# EasyEDA Pro project 3SE_24_Power_Rune.eprj, schematic Armour (continued)
## Sheets (continued)
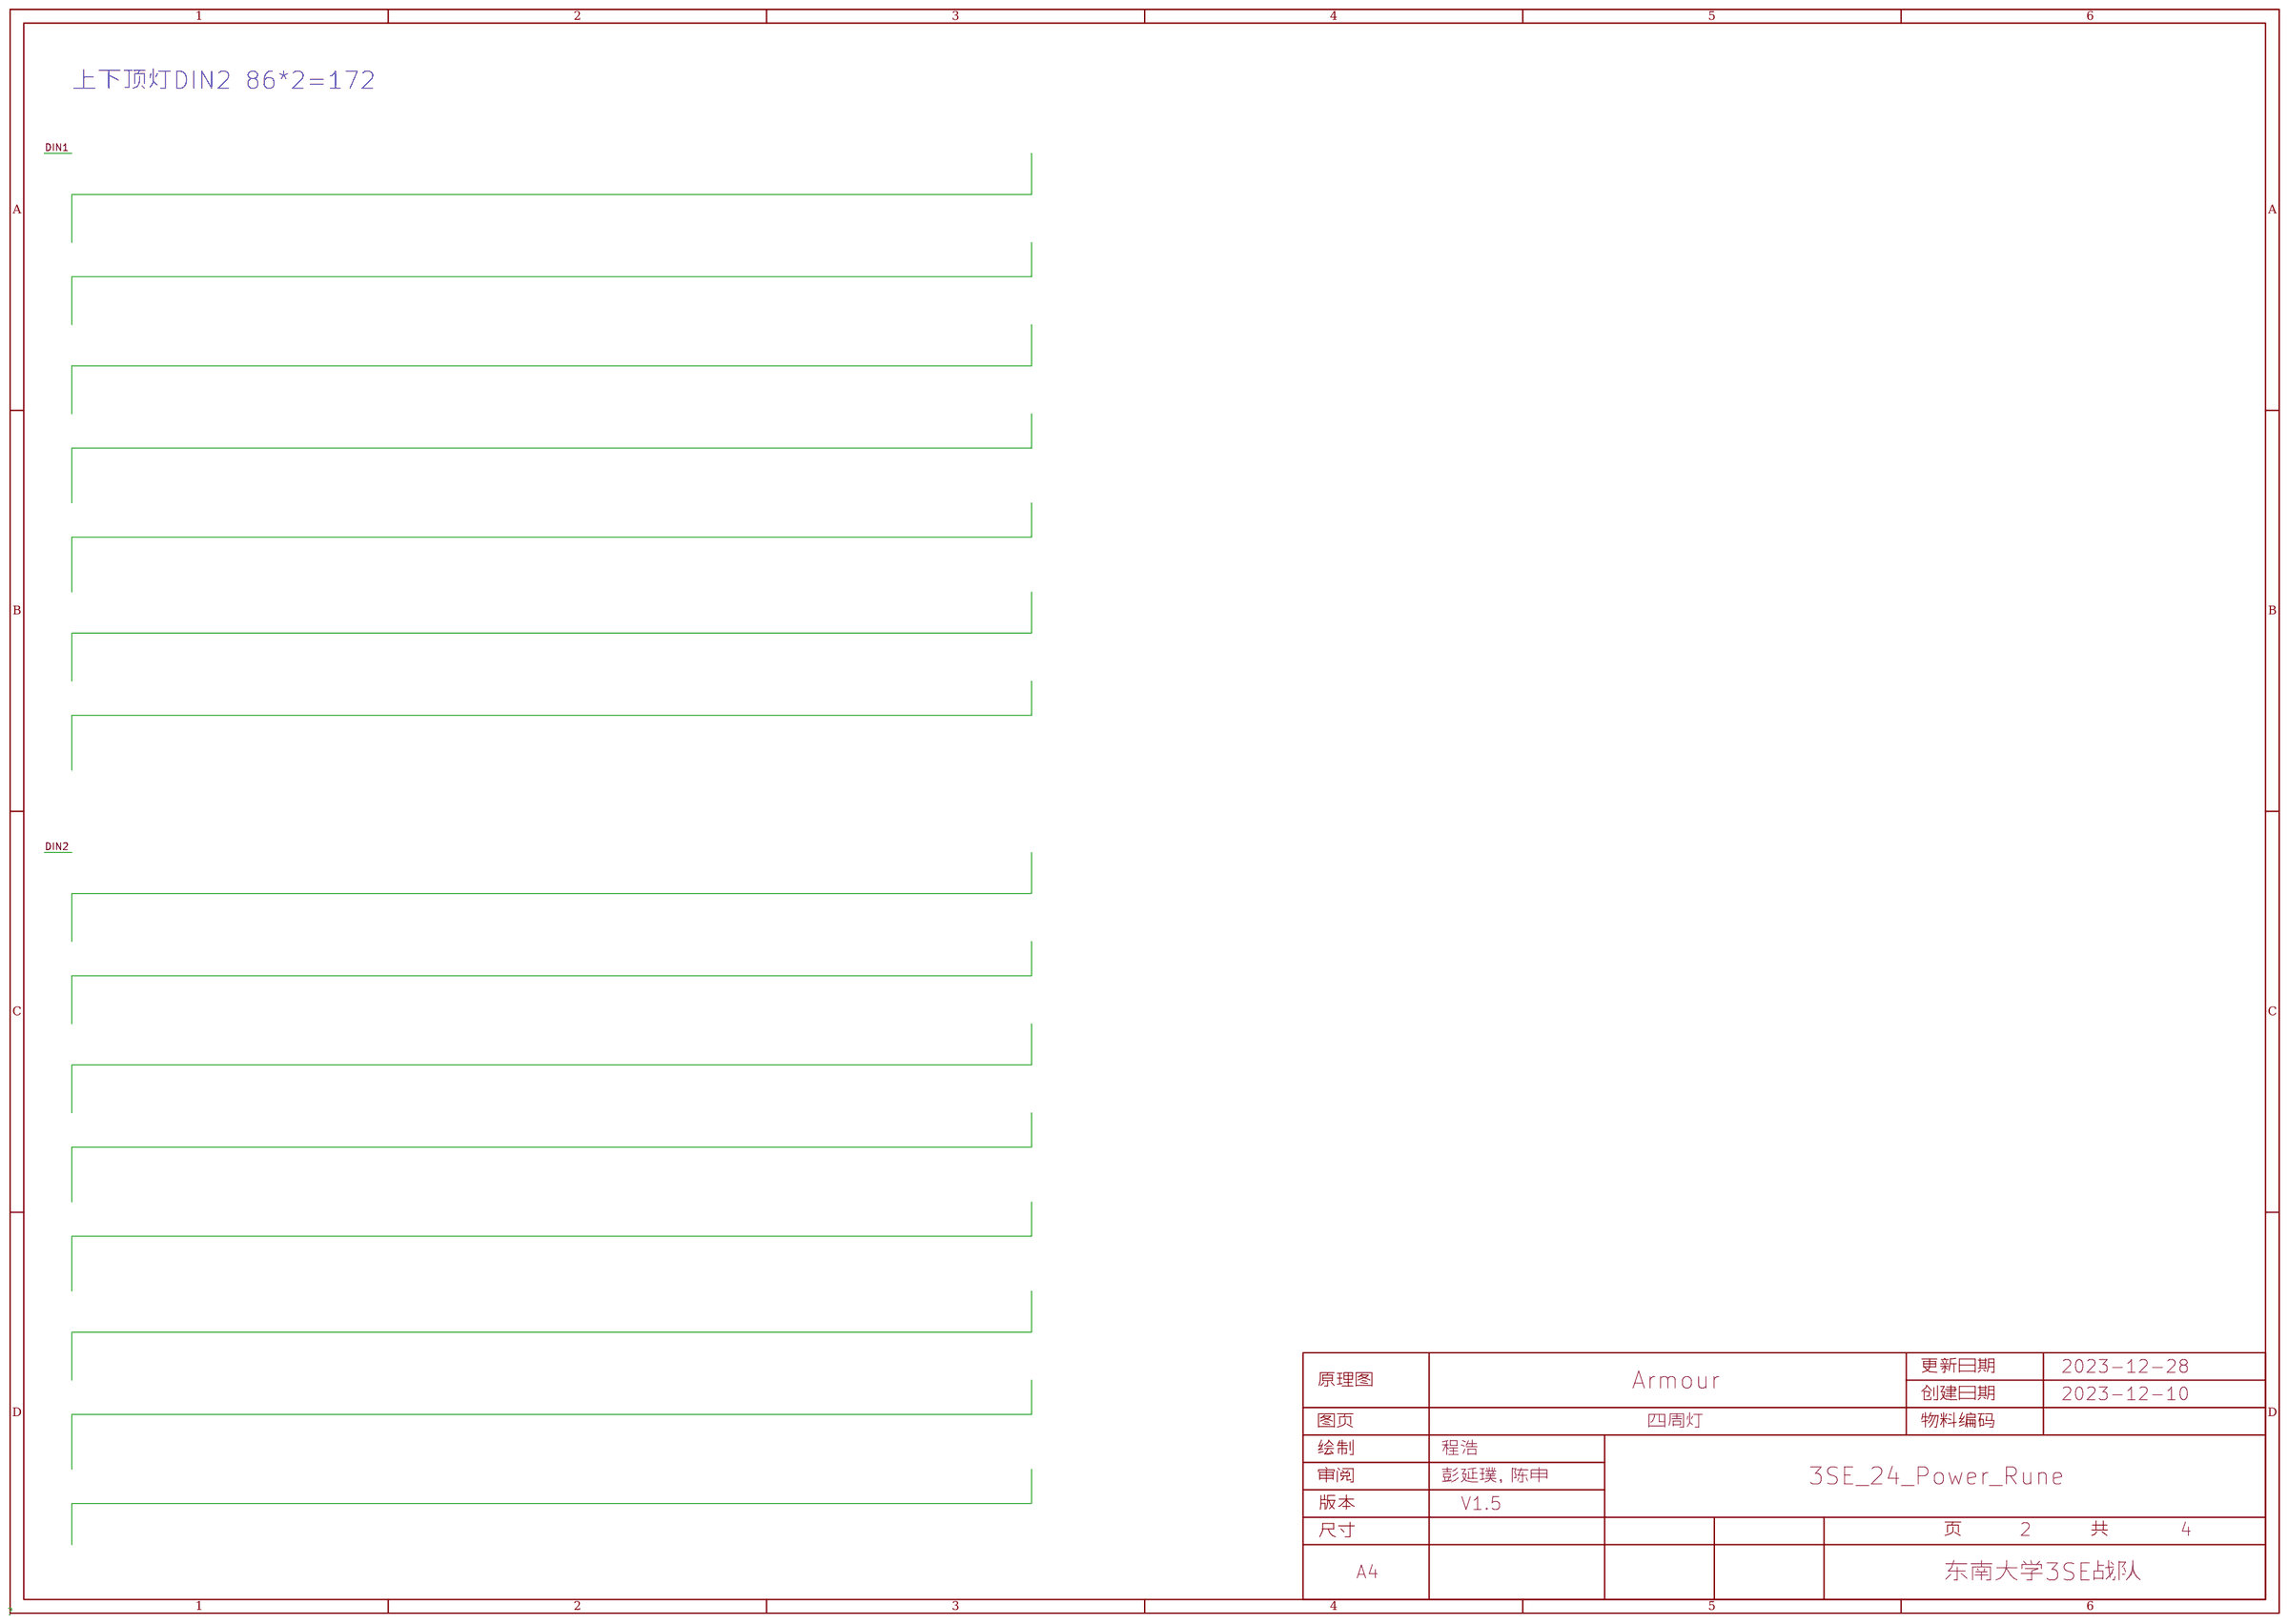
[diagram p5: 四周灯]

## Parts
sheet 主控和电源
3V3  -  [Test-Point-0.5mm]
5V  -  [Test-Point-0.5mm]
24V  -  [Test-Point-0.5mm]
C431  1uF  [C0603]
C432  470uF  [CAP-SMD_BD10.0-L10.3-W10.3-LS11.0-FD]
C433  1uF  [C0603]
C434  10uF  [C0603]
C435  100nF  [C0603]
C436  1000uF  [CAP-SMD_BD12.5-L13.0-W13.0-RD]
C437  1uF  [C0603]
C438  33nF  [C0603]
C439  100nF  [C0603]
C440  10uF  [C0603]
C441  100nF  [C0603]
C442  100nF  [C0603]
C443  100nF  [C0603]
C444  100nF  [C0603]
C445  1uF  [C0603]
C446  100nF  [C0603]
C447  100nF  [C0603]
C448  100nF  [C0603]
C449  100nF  [C0603]
C450  1uF  [C0603]
C451  100nF  [C0603]
C452  12pF  [C0603]
C453  100nF  [C0603]
C454  12pF  [C0603]
C456  100nF  [C0603]
C457  100nF  [C0603]
CN1  XT30PW-M  [CONN-TH_XT30PW-M]
CN2  SM03B-GHS-TB(LF)(SN)  [CONN-TH_SM03B-GHS-TB-LF-SN]
CN3  SM03B-GHS-TB(LF)(SN)  [CONN-TH_SM03B-GHS-TB-LF-SN]
CN4  HC-GH-2PWT  [CONN-SMD_2P-P1.25_HCTL_HC-GH-2PWTKK]
CN5  XT30PW-F  [CONN-TH_XT30PW-F-1]
CN6  WAFER-GH1.25-4PWB  [CONN-SMD_4P-P1.25_XUNPU_WAFER-GH1.25-4PWB]
D1  ESDBM24VD3  [SOD-323_L1.7-W1.3-LS2.6-BI]
D2  SB1045L  [TO-277_3P-L5.4-W4.0-LS6.5-TR]
D3  SMBJ6.0CA  [SMB_L4.6-W3.6-LS5.3-BI]
D4  USBLC6-2SC6  [SOT-23-6_L2.9-W1.6-P0.95-LS2.8-BL]
L1  47uH  [IND-SMD_L17.5-W17.2]
LED431  NCD0603R1  [LED0603-RD_RED]
R1  10kΩ  [R0603]
R2  10kΩ  [R0603]
R3  10kΩ  [R0603]
R4  1kΩ  [R0603]
R5  10kΩ  [R0603]
R6  3.3kΩ  [R0603]
R7  1kΩ  [R0603]
R8  10kΩ  [R0603]
R9  1kΩ  [R0603]
R10  1kΩ  [R0603]
R11  10kΩ  [R0603]
R12  10kΩ  [R0603]
R13  1kΩ  [R0603]
R14  10kΩ  [R0603]
R15  10kΩ  [R0603]
R16  1kΩ  [R0603]
R17  10kΩ  [R0603]
R18  10kΩ  [R0603]
R19  1kΩ  [R0603]
R20  10kΩ  [R0603]
R21  1kΩ  [R0603]
R22  10kΩ  [R0603]
R23  10kΩ  [R0603]
R24  10kΩ  [R0603]
R25  10kΩ  [R0603]
R26  10kΩ  [R0603]
R27  1kΩ  [R0603]
R28  10kΩ  [R0603]
R29  1kΩ  [R0603]
R30  1kΩ  [R0603]
R31  10kΩ  [R0603]
R32  5.1kΩ  [R0603]
R33  5.1kΩ  [R0603]
SW1  TS-1101-C-W  [SW-SMD_L6.0-W3.3-LS8.0]
SW2  TS-1101-C-W  [SW-SMD_L6.0-W3.3-LS8.0]
SW3  DSHP01TSGER  [SW-SMD_DSHP01TSGER]
U1  XL4016E1  [TO-220-5_L15.5-W10.5-P1.70-BL_ON_CASE-314A-03]
U2  AMS1117-3.3  [SOT-223-4_L6.5-W3.5-P2.30-LS7.0-BR]
U3  ESP32-S3-WROOM-1-N8R2  [WIRELM-SMD_ESP32-S3-WROOM-1]
U4  74HC4051D,653  [SOIC-16_L9.9-W3.9-P1.27-LS6.0-BL]
USB1  TYPE-C 16PIN 2MD(073)  [USB-C-SMD_TYPE-C-6PIN-2MD-073]
X1  32.768kHz  [FC-135R_L3.2-W1.5]
sheet 十环灯
CBB1  -
CBB2  -
CBB3  -
CBB4  -
CBB5  -
CBB6  -
CBB7  -
CBB8  -
CBB9  -
CBB10  -
CBB11  -
CBB12  -
CBB13  -
CBB14  -
CBB15  -
CBB16  -
CBB17  -
CBB18  -
CBB19  -
CBB20  -
CBB21  -
CBB22  -
CBB23  -
CBB24  -
CBB25  -
CBB26  -
CBB27  -
CBB28  -
CBB29  -
CBB30  -
CBB31  -
CBB32  -
CBB33  -
CBB34  -
CBB35  -
CBB36  -
CBB37  -
CBB38  -
CBB39  -
CBB40  -
CBB41  -
CBB42  -
CBB43  -
CBB44  -
CBB45  -
CBB46  -
CBB47  -
CBB48  -
CBB49  -
CBB50  -
CBB51  -
CBB52  -
CBB53  -
CBB54  -
CBB55  -
CBB56  -
CBB57  -
CBB58  -
CBB59  -
CBB60  -
CBB61  -
CBB62  -
CBB63  -
CBB64  -
CBB65  -
CBB66  -
CBB67  -
CBB68  -
CBB69  -
CBB70  -
CBB71  -
CBB72  -
CBB73  -
CBB74  -
CBB75  -
CBB76  -
CBB77  -
CBB78  -
CBB79  -
CBB80  -
CBB81  -
CBB82  -
CBB83  -
CBB84  -
CBB85  -
CBB86  -
CBB87  -
CBB88  -
CBB89  -
CBB90  -
CBB91  -
CBB92  -
CBB93  -
CBB94  -
CBB95  -
CBB96  -
CBB97  -
CBB98  -
CBB99  -
CBB100  -
CBB101  -
CBB102  -
CBB103  -
CBB104  -
CBB105  -
CBB106  -
CBB107  -
CBB108  -
CBB109  -
CBB110  -
CBB111  -
CBB112  -
CBB113  -
CBB114  -
CBB115  -
CBB116  -
CBB117  -
CBB118  -
CBB119  -
CBB120  -
CBB121  -
CBB122  -
CBB123  -
CBB124  -
CBB125  -
CBB126  -
CBB127  -
CBB128  -
CBB129  -
CBB130  -
CBB131  -
CBB132  -
CBB133  -
CBB134  -
CBB135  -
CBB136  -
CBB137  -
CBB138  -
CBB139  -
CBB140  -
CBB141  -
CBB142  -
CBB143  -
CBB144  -
CBB145  -
CBB146  -
CBB147  -
CBB148  -
CBB149  -
CBB150  -
CBB151  -
CBB152  -
CBB153  -
CBB154  -
CBB155  -
CBB156  -
CBB157  -
CBB158  -
CBB159  -
CBB160  -
CBB161  -
CBB162  -
CBB163  -
CBB164  -
CBB165  -
CBB166  -
CBB167  -
CBB168  -
CBB169  -
CBB170  -
CBB171  -
CBB172  -
CBB173  -
CBB174  -
CBB175  -
CBB176  -
CBB177  -
CBB178  -
CBB179  -
CBB180  -
CBB181  -
CBB182  -
CBB183  -
CBB184  -
CBB185  -
CBB186  -
CBB187  -
CBB188  -
CBB189  -
CBB190  -
CBB191  -
CBB192  -
CBB193  -
CBB194  -
CBB195  -
CBB196  -
CBB197  -
CBB198  -
CBB199  -
CBB200  -
CBB201  -
CBB202  -
CBB203  -
CBB204  -
CBB205  -
CBB206  -
CBB207  -
CBB208  -
CBB209  -
CBB210  -
CBB211  -
CBB212  -
CBB213  -
CBB214  -
CBB215  -
CBB216  -
CBB217  -
CBB218  -
CBB219  -
CBB220  -
CBB221  -
CBB222  -
CBB223  -
CBB224  -
CBB225  -
CBB226  -
CBB227  -
CBB228  -
CBB229  -
CBB230  -
CBB231  -
CBB232  -
CBB233  -
CBB234  -
CBB235  -
CBB236  -
CBB237  -
CBB238  -
CBB239  -
CBB240  -
CBB241  -
CBB242  -
CBB243  -
CBB244  -
CBB245  -
CBB246  -
CBB247  -
CBB248  -
CBB249  -
CBB250  -
CBB251  -
CBB252  -
CBB253  -
CBB254  -
CBB255  -
CBB256  -
CBB257  -
CBB258  -
sheet 四周灯
CBB259  -
CBB260  -
CBB261  -
CBB262  -
CBB263  -
CBB264  -
CBB265  -
CBB266  -
CBB267  -
CBB268  -
CBB269  -
CBB270  -
CBB271  -
CBB272  -
CBB273  -
CBB274  -
CBB275  -
CBB276  -
CBB277  -
CBB278  -
CBB279  -
CBB280  -
CBB281  -
CBB282  -
CBB283  -
CBB284  -
CBB285  -
CBB286  -
CBB287  -
CBB288  -
CBB289  -
CBB290  -
CBB291  -
CBB292  -
CBB293  -
CBB294  -
CBB295  -
CBB296  -
CBB297  -
CBB298  -
CBB299  -
CBB300  -
CBB301  -
CBB302  -
CBB303  -
CBB304  -
CBB305  -
CBB306  -
CBB307  -
CBB308  -
CBB309  -
CBB310  -
CBB311  -
CBB312  -
CBB313  -
CBB314  -
CBB315  -
CBB316  -
CBB317  -
CBB318  -
CBB319  -
CBB320  -
CBB321  -
CBB322  -
CBB323  -
CBB324  -
CBB325  -
CBB326  -
CBB327  -
CBB328  -
CBB329  -
CBB330  -
CBB331  -
CBB332  -
CBB333  -
CBB334  -
CBB335  -
CBB336  -
CBB337  -
CBB338  -
CBB339  -
CBB340  -
CBB341  -
CBB342  -
CBB343  -
CBB344  -
CBB345  -
CBB346  -
CBB347  -
CBB348  -
CBB349  -
CBB350  -
CBB351  -
CBB352  -
CBB353  -
CBB354  -
CBB355  -
CBB356  -
CBB357  -
CBB358  -
CBB359  -
CBB360  -
CBB361  -
CBB362  -
CBB363  -
CBB364  -
CBB365  -
CBB366  -
CBB367  -
CBB368  -
CBB369  -
CBB370  -
CBB371  -
CBB372  -
CBB373  -
CBB374  -
CBB375  -
CBB376  -
CBB377  -
CBB378  -
CBB379  -
CBB380  -
CBB381  -
CBB382  -
CBB383  -
CBB384  -
CBB385  -
CBB386  -
CBB387  -
CBB388  -
CBB389  -
CBB390  -
CBB391  -
CBB392  -
CBB393  -
CBB394  -
CBB395  -
CBB396  -
CBB397  -
CBB398  -
CBB399  -
CBB400  -
CBB401  -
CBB402  -
CBB403  -
CBB404  -
CBB405  -
CBB406  -
CBB407  -
CBB408  -
CBB409  -
CBB410  -
CBB411  -
CBB412  -
CBB413  -
CBB414  -
CBB415  -
CBB416  -
CBB417  -
CBB418  -
CBB419  -
CBB420  -
CBB421  -
CBB422  -
CBB423  -
CBB424  -
CBB425  -
CBB426  -
CBB427  -
CBB428  -
CBB429  -
CBB430  -
CBB431  -
CBB432  -
CBB433  -
CBB434  -
CBB435  -
CBB436  -
sheet 按键
KEY1  -  [热插拔轴座]
KEY2  -  [热插拔轴座]
KEY3  -  [热插拔轴座]
KEY4  -  [热插拔轴座]
KEY5  -  [热插拔轴座]
KEY6  -  [热插拔轴座]
KEY7  -  [热插拔轴座]
KEY8  -  [热插拔轴座]
KEY9  -  [热插拔轴座]
KEY10  -  [热插拔轴座]
KEY11  -  [热插拔轴座]
KEY12  -  [热插拔轴座]
KEY13  -  [热插拔轴座]
KEY14  -  [热插拔轴座]
KEY15  -  [热插拔轴座]
KEY16  -  [热插拔轴座]
KEY17  -  [热插拔轴座]
KEY18  -  [热插拔轴座]
KEY19  -  [热插拔轴座]
KEY20  -  [热插拔轴座]
KEY21  -  [热插拔轴座]
KEY22  -  [热插拔轴座]
KEY23  -  [热插拔轴座]
KEY24  -  [热插拔轴座]
KEY25  -  [热插拔轴座]
KEY26  -  [热插拔轴座]
KEY27  -  [热插拔轴座]
KEY28  -  [热插拔轴座]
KEY29  -  [热插拔轴座]
KEY30  -  [热插拔轴座]
KEY31  -  [热插拔轴座]
KEY32  -  [热插拔轴座]
KEY33  -  [热插拔轴座]
KEY34  -  [热插拔轴座]
KEY35  -  [热插拔轴座]
KEY36  -  [热插拔轴座]
KEY37  -  [热插拔轴座]
KEY38  -  [热插拔轴座]
KEY39  -  [热插拔轴座]
KEY40  -  [热插拔轴座]
KEY41  -  [热插拔轴座]
KEY42  -  [热插拔轴座]
KEY43  -  [热插拔轴座]
KEY44  -  [热插拔轴座]
KEY45  -  [热插拔轴座]
KEY46  -  [热插拔轴座]
KEY47  -  [热插拔轴座]
KEY48  -  [热插拔轴座]
KEY49  -  [热插拔轴座]
KEY50  -  [热插拔轴座]
KEY51  -  [热插拔轴座]

## Library data of the parts
3V3 5V 24V = Test-Point: Test Point 测试点; Check: false
C431 C433 C437 C445 C450 = CL10A105KB8NNNC: 容值:1uF;精度:±10%;额定电压:50V;材质(温度系数):X5R;; LCSC Part Name: 1uF ±10% 50V; Supplier Part: C15849; Manufacturer: SAMSUNG(三星); Supplier Footprint: 0603; JLCPCB Part Class: Basic Part; Datasheet: https://atta.szlcsc.com/upload/public/pdf/source/20160218/1457707763339.pdf; Supplier: LCSC; Tolerance: ±10%; Voltage Rated: 50V; Temperature Coefficient: X5R
C432 = RVT470UF35V67RV0056: 容值:470uF;精度:±20%;额定电压:35V;纹波电流:286mA@120Hz;等效串联电阻:-;; LCSC Part Name: 470uF ±20% 35V; Supplier Part: C2836436; Manufacturer: KNSCHA(科尼盛); Supplier Footprint: SMD,D10xL10.2mm; JLCPCB Part Class: 扩展库; Datasheet: https://atta.szlcsc.com/upload/public/pdf/source/20210528/C2836436_C8D3EEA5E3C1CA7F9FA48FC22CF12531.pdf; Supplier: LCSC; Tolerance: ±20%; Rated Voltage: 35V; Ripple Current: 286mA@120Hz; φD: 10mm; L: 10.2mm; Lifetime @ Temp: 2000hrs@105℃; Operating Temperature: -55℃~+105℃
C434 C440 = CL10A106KP8NNNC: 容值:10uF;精度:±10%;额定电压:10V;材质(温度系数):X5R;; LCSC Part Name: 10uF ±10% 10V; Supplier Part: C19702; Manufacturer: SAMSUNG(三星); Supplier Footprint: 0603; JLCPCB Part Class: Basic Part; Datasheet: https://atta.szlcsc.com/upload/public/pdf/source/20160218/1457707763339.pdf; Supplier: LCSC; Tolerance: ±10%; Voltage Rated: 10V; Temperature Coefficient: X5R
C435 C439 C441-C444 C446-C449 C451 C453 C456 C457 = CC0603KRX7R9BB104: 容值:100nF;精度:±10%;额定电压:50V;材质(温度系数):X7R;; LCSC Part Name: 100nF ±10% 50V; Supplier Part: C14663; Manufacturer: YAGEO(国巨); Supplier Footprint: 0603; JLCPCB Part Class: Basic Part; Datasheet: https://atta.szlcsc.com/upload/public/pdf/source/20180910/C282072_33301C7F631E79921B82A8DAC6BCC5B3.pdf; Supplier: LCSC; Tolerance: ±10%; Voltage Rated: 50V; Temperature Coefficient: X7R
C436 = RVT1E102M1213: 容值:1000uF;精度:±20%;额定电压:25V;纹波电流:468mA@120Hz;等效串联电阻:-;; LCSC Part Name: 1000uF ±20% 25V; Supplier Part: C90271; Manufacturer: ROQANG(容强); Supplier Footprint: SMD,D12.5xL13.5mm; JLCPCB Part Class: 扩展库; Datasheet: https://atta.szlcsc.com/upload/public/pdf/source/20170325/1490427950282.pdf; Supplier: LCSC; Tolerance: ±20%; Rated Voltage: 25V; Ripple Current: 468mA@120Hz; φD: 12.5mm; L: 13.5mm; Lifetime @ Temp: 2000hrs@105℃; Operating Temperature: -40℃~+105℃
C438 = 0603B333K500NT: 容值:33nF;精度:±10%;额定电压:50V;材质(温度系数):X7R;; LCSC Part Name: 33nF ±10% 50V; Supplier Part: C1614; Manufacturer: FH(风华); Supplier Footprint: 0603; JLCPCB Part Class: 扩展库; Datasheet: https://atta.szlcsc.com/upload/public/pdf/source/20200305/C486355_26A10D38EF8C2A5C37091D0039909270.pdf; Supplier: LCSC; Tolerance: ±10%; Voltage Rated: 50V; Temperature Coefficient: X7R
C452 C454 = CL10C120JB8NNNC: 容值:12pF;精度:±5%;额定电压:50V;材质(温度系数):C0G;; LCSC Part Name: 12pF ±5% 50V; Supplier Part: C38523; Manufacturer: SAMSUNG(三星); Supplier Footprint: 0603; JLCPCB Part Class: Basic Part; Datasheet: https://atta.szlcsc.com/upload/public/pdf/source/20160218/1457707763339.pdf; Supplier: LCSC; Tolerance: ±5%; Voltage Rated: 50V; Temperature Coefficient: C0G
CN1 = XT30PW-M: 类别:-;类型1:-;; LCSC Part Name: AMASS(艾迈斯)航模插头 卧式弯脚 XT30PW-M公头; Supplier Part: C431092; Manufacturer: AMASS(艾迈斯); JLCPCB Part Class: 扩展库; Datasheet: https://atta.szlcsc.com/upload/public/pdf/source/20220222/6A9F22F7850E25B33E1BE430ADF8560B.pdf; Supplier: LCSC; Brand: 艾迈斯; Type: 航模插头; RatedVoltage: DC 500V; InterfaceType: 公头; RatedCurrent: 15A; RecommendedWireGauge: 16/18/20AWG; contact resistance: 1.2mΩ; specifications: 2pin
CN2 CN3 = SM03B-GHS-TB(LF)(SN): 插针结构:1x3P;间距:1.25mm;安装方式:卧贴;行距:-;总PIN数:3P;排数:1;每排PIN数:3;参考系列:GH;额定电流:1A;触头材质:磷青铜;触头镀层:锡;工作温度范围:-25℃~+85℃;; LCSC Part Name: 1x3P 间距:1.25mm 卧贴 系列:GH GH系列; Supplier Part: C514175; Manufacturer: JST; Supplier Footprint: SMD,P=1.25mm; JLCPCB Part Class: Extended Part; Datasheet: https://atta.szlcsc.com/upload/public/pdf/source/20200416/C514175_6D761544780BFF1FCAB26BE8A747A99F.pdf; Supplier: LCSC; Pins Structure: 1x3P; Pitch: 1.25mm; Mounting Style: 卧贴; Number of Pins: 3P; Number of Rows: 1; Number of PINs Per Row: 3; Reference Series: GH; Current Rating (Max): 1A; Contact Material: 磷青铜; Contact Plating: 锡; Operating Temperature Range: -25℃~+85℃
CN4 = HC-GH-2PWT_C3011944: 插针结构:1x2P;间距:1.25mm;安装方式:卧贴;总PIN数:2P;排数:1;每排PIN数:2;参考系列:GH;额定电流:1A;工作温度范围:-25℃~+85℃;; LCSC Part Name: 1x2P 间距:1.25mm 卧贴 系列:GH 卧式贴片带扣 镀锡 2P; Supplier Part: C3011944; Manufacturer: HCTL(华灿天禄); Supplier Footprint: SMD,P=1.25mm; JLCPCB Part Class: 扩展库; Datasheet: https://atta.szlcsc.com/upload/public/pdf/source/20210728/C2845397_2BAB5616F3DD52263F1EF5392BF0F2D4.pdf; Supplier: LCSC; Pins Structure: 1x2P; Pitch: 1.25mm; Mounting Style: 卧贴; Number of Pins: 2P; Number of Rows: 1; Number of PINs Per Row: 2; Reference Series: GH; Current Rating (Max): 1A; Operating Temperature Range: -25℃~+85℃
CN5 = XT30PW-F: 类别:-;类型1:-;; LCSC Part Name: AMASS(艾迈斯)电源连接器 母头 XT30PW-F; Supplier Part: C2913282; Manufacturer: AMASS(艾迈斯); JLCPCB Part Class: 扩展库; Datasheet: https://atta.szlcsc.com/upload/public/pdf/source/20190916/C428722_DFF78979486FCB0B58C1FC563067EC88.pdf; Supplier: LCSC; Brand: 艾迈斯; Type: 航模插头; InterfaceType: 母头
CN6 = WAFER-GH1.25-4PWB: 参考系列:GH;间距:1.25mm;插针结构:1x4P;排数:1;每排PIN数:4;公母:公型插针;安装方式:卧贴;额定电流:1A;工作温度范围:-25℃~+85℃;; LCSC Part Name: GH1.25mm 4P 卧贴带扣 带扣; Supplier Part: C3029379; Manufacturer: XUNPU(讯普); Supplier Footprint: SMD,P=1.25mm; JLCPCB Part Class: 扩展库; Datasheet: https://atta.szlcsc.com/upload/public/pdf/source/20220527/CB8773BFB0913C3B8ABD62CB38BA101A.pdf; Supplier: LCSC; Reference Series: GH; Pitch: 1.25mm; Pins Structure: 1x4P; Number of Rows: 1; Number of PINs Per Row: 4; Gender: 公型插针; Mounting Style: 卧贴; Current Rating (Max): 1A; Operating Temperature Range: -25℃~+85℃
D1 = ESDBM24VD3: 反向截止电压(Vrwm):24V;最大钳位电压:48V;峰值脉冲电流(Ipp):9A;峰值脉冲功率(Ppp):475W;击穿电压:32V;; LCSC Part Name: VRWM:24V; Supplier Part: C5295707; Manufacturer: CJ(江苏长电/长晶); Supplier Footprint: SOD-323; JLCPCB Part Class: 扩展库; Datasheet: https://atta.szlcsc.com/upload/public/pdf/source/20221212/AA00F3F9D555C577265308AA0E0D778D.pdf; Supplier: LCSC; Reverse Stand-Off Voltage (Vrwm): 24V; Maximum Clamping Voltage: 48V; Peak Pulse Current (Ipp): 9A; Peak Pulse Power Dissipation (Ppp): 475W; Breakdown Voltage: 32V; Reverse Leakage Current (Ir): 1uA; Type: ESD
D2 = SB1045L_C908747: 二极管配置:独立式;正向压降(Vf):530mV@10A;直流反向耐压(Vr):45V;平均整流电流(Io):10A;; LCSC Part Name: 电压:45V 电流:10A; Supplier Part: C908747; Manufacturer: GOODWORK(固得沃克); Supplier Footprint: TO-277; JLCPCB Part Class: 扩展库; Datasheet: https://atta.szlcsc.com/upload/public/pdf/source/20210105/C908747_DE348528BC53D9CC51537B568EB9903F.pdf; Supplier: LCSC; Diode Configuration: 独立式; Forward Voltage (Vf@If): 530mV@10A; Reverse Voltage (Vr): 45V; Average Rectified Current (Io): 10A; Reverse Leakage Current (Ir): 150uA@45V
D3 = SMBJ6.0CA_C113977: 反向截止电压(Vrwm):6V;最大钳位电压:10.3V;峰值脉冲电流(Ipp)@10/1000us:58.3A;击穿电压:6.67V;; LCSC Part Name: 双向 Vrwm:6V; Supplier Part: C113977; Manufacturer: MDD; Supplier Footprint: SMB(DO-214AA); JLCPCB Part Class: 扩展库; Datasheet: https://atta.szlcsc.com/upload/public/pdf/source/20230314/C8F66EF07395B88C11214ABD10019202.pdf; Supplier: LCSC; Reverse Stand-Off Voltage (Vrwm): 6V; Maximum Clamping Voltage: 10.3V; Peak Pulse Current (Ipp)@10/1000us: 58.3A; Breakdown Voltage: 6.67V; Reverse Leakage Current (Ir): 800uA; Type: TVS
D4 = USBLC6-2SC6_C7519: 极性:单向;反向截止电压(Vrwm):5.25V;最大钳位电压:17V;峰值脉冲电流(Ipp)@10/1000us:5A;击穿电压:6V;; LCSC Part Name: 单向ESD; Supplier Part: C7519; Manufacturer: ST(意法半导体); Supplier Footprint: SOT-23-6; JLCPCB Part Class: 扩展库; Datasheet: https://atta.szlcsc.com/upload/public/pdf/source/20140724/1457707160627.pdf; Supplier: LCSC; polarity: 单向; Reverse Stand-Off Voltage (Vrwm): 5.25V; Maximum Clamping Voltage: 17V; Peak Pulse Current (Ipp)@10/1000us: 5A; Breakdown Voltage: 6V; Number of Lines: 双路; Operating Temperature: -40℃~+125℃@(Tj); Type: ESD
L1 = SMMS1770-470M: 类型:一体成型电感;电感值:47uH;精度:±20%;额定电流:8.7A;饱和电流(Isat):16A;; LCSC Part Name: 47uH ±20% 16A; Supplier Part: C2976971; Manufacturer: SXN(顺翔诺); Supplier Footprint: SMD,17.5x17.15x7mm; JLCPCB Part Class: 扩展库; Datasheet: https://atta.szlcsc.com/upload/public/pdf/source/20220224/D8C8E12B51A4AD75CA32F676574334C0.pdf; Supplier: LCSC; Type: 一体成型电感; Tolerance: ±20%; Rated Current: 8.7A; Saturation Current (Isat): 16A; DC Resistance (DCR): 55mΩ
LED431 = NCD0603R1_C84263: 发光颜色:红灯;; LCSC Part Name: 红灯 0603红灯   正贴; Supplier Part: C84263; Manufacturer: 国星光电; Supplier Footprint: 0603; JLCPCB Part Class: 扩展库; Datasheet: https://atta.szlcsc.com/upload/public/pdf/source/20200820/C84263_DABC6A75E58F576973B407FDBA283D60.pdf; Supplier: LCSC; Emitted Color: 红灯
R1-R3 R5 R8 R11 R12 R14 R15 R17 R18 R20 R22-R26 R28 R31 = 0603WAF1002T5E: 阻值:10kΩ;精度:±1%;功率:100mW;温度系数:±100ppm/℃;电阻类型:厚膜电阻;; LCSC Part Name: 10kΩ ±1% 100mW 厚膜电阻; Supplier Part: C25804; Manufacturer: UNI-ROYAL(厚声); Supplier Footprint: 0603; JLCPCB Part Class: Basic Part; Datasheet: https://atta.szlcsc.com/upload/public/pdf/source/20200306/C422600_1E6D84923E4A46A82E41ADD87F860B5C.pdf; Supplier: LCSC; Tolerance: ±1%; Power(Watts): 100mW; Overload Voltage (Max): 75V; Temperature Coefficient: ±100ppm/℃; Type: 厚膜电阻; Operating Temperature Range: -55℃~+155℃
R4 R7 R9 R10 R13 R16 R19 R21 R27 R29 = 0603WAF1001T5E: 阻值:1kΩ;精度:±1%;功率:100mW;温度系数:±100ppm/℃;电阻类型:厚膜电阻;; LCSC Part Name: 1kΩ ±1% 100mW 厚膜电阻; Supplier Part: C21190; Manufacturer: UNI-ROYAL(厚声); Supplier Footprint: 0603; JLCPCB Part Class: Basic Part; Datasheet: https://atta.szlcsc.com/upload/public/pdf/source/20200306/C422600_1E6D84923E4A46A82E41ADD87F860B5C.pdf; Supplier: LCSC; Type: 厚膜电阻; Tolerance: ±1%; Power(Watts): 100mW; Temperature Coefficient: ±100ppm/℃; Overload Voltage (Max): 75V; Operating Temperature Range: -55℃~+155℃
R6 = 0603WAF3301T5E: 阻值:3.3kΩ;精度:±1%;功率:100mW;温度系数:±100ppm/℃;电阻类型:厚膜电阻;; LCSC Part Name: 3.3kΩ ±1% 100mW 厚膜电阻; Supplier Part: C22978; Manufacturer: UNI-ROYAL(厚声); Supplier Footprint: 0603; JLCPCB Part Class: Basic Part; Datasheet: https://atta.szlcsc.com/upload/public/pdf/source/20200306/C422600_1E6D84923E4A46A82E41ADD87F860B5C.pdf; Supplier: LCSC; Tolerance: ±1%; Power(Watts): 100mW; Overload Voltage (Max): 75V; Temperature Coefficient: ±100ppm/℃; Type: 厚膜电阻; Operating Temperature Range: -55℃~+155℃
R30 = 0603WAF1001T5E: 电阻类型:厚膜电阻;阻值:1kΩ;精度:±1%;功率:100mW;温度系数:±100ppm/℃;; LCSC Part Name: 厚膜电阻 1kΩ ±1% 100mW; Supplier Part: C21190; Manufacturer: UNI-ROYAL(厚声); Supplier Footprint: 0603; JLCPCB Part Class: Basic Part; Datasheet: https://atta.szlcsc.com/upload/public/pdf/source/20200306/C422600_1E6D84923E4A46A82E41ADD87F860B5C.pdf; Supplier: LCSC; Type: 厚膜电阻; Tolerance: ±1%; Power(Watts): 100mW; Temperature Coefficient: ±100ppm/℃; Overload Voltage (Max): 75V; Operating Temperature Range: -55℃~+155℃
R32 R33 = 0603WAF5101T5E: 电阻类型:厚膜电阻;阻值:5.1kΩ;精度:±1%;功率:100mW;; LCSC Part Name: 5.1kΩ ±1% 100mW; Supplier Part: C23186; Manufacturer: UNI-ROYAL(厚声); Supplier Footprint: 0603; JLCPCB Part Class: Basic Part; Datasheet: https://atta.szlcsc.com/upload/public/pdf/source/20200306/C422600_1E6D84923E4A46A82E41ADD87F860B5C.pdf; Supplier: LCSC; Type: 厚膜电阻; Tolerance: ±1%; Power(Watts): 100mW; Temperature Coefficient: ±100ppm/℃; Overload Voltage (Max): 75V; Operating Temperature Range: -55℃~+155℃
SW1 SW2 = TS-1101-C-W: 触点电流:50mA;额定电压(AC):-;额定电压(DC):12V;额定功率:-;绝缘电阻:-;电路结构:单刀单掷;安装方式:立贴;带灯:无;作用力:260gf;机械寿命:5万次;带支架:否;; LCSC Part Name: 立贴 6*3.6*2.5mm 轻触开关 一型3*6*2.5有白ZD b拉伸白色带淡绿按键 卷装; Supplier Part: C318938; Manufacturer: XKB Connectivity(中国星坤); Supplier Footprint: SMD; JLCPCB Part Class: 扩展库; Datasheet: https://atta.szlcsc.com/upload/public/pdf/source/20200227/C318938_C2E53B1EEDE37D980A33616AC086DE53.pdf; Supplier: LCSC; Contact Current: 50mA; Voltage Rating (DC): 12V; Circuit: 单刀单掷; Mounting Style: 立贴; Actuator Style: 矩形按钮; Actuator/Cap Color: 白色带淡绿; With Lamp: 无; Operating Force: 260gf; Mechanical Life: 5万次; Operating Temperature: -30℃~+85℃; Switch Length: 6mm; Switch Width: 3.6mm; Switch Height: 2.5mm; Strike Gundam: 否